# EasyEDA Pro project MSDRV3.eprj, board PCB7
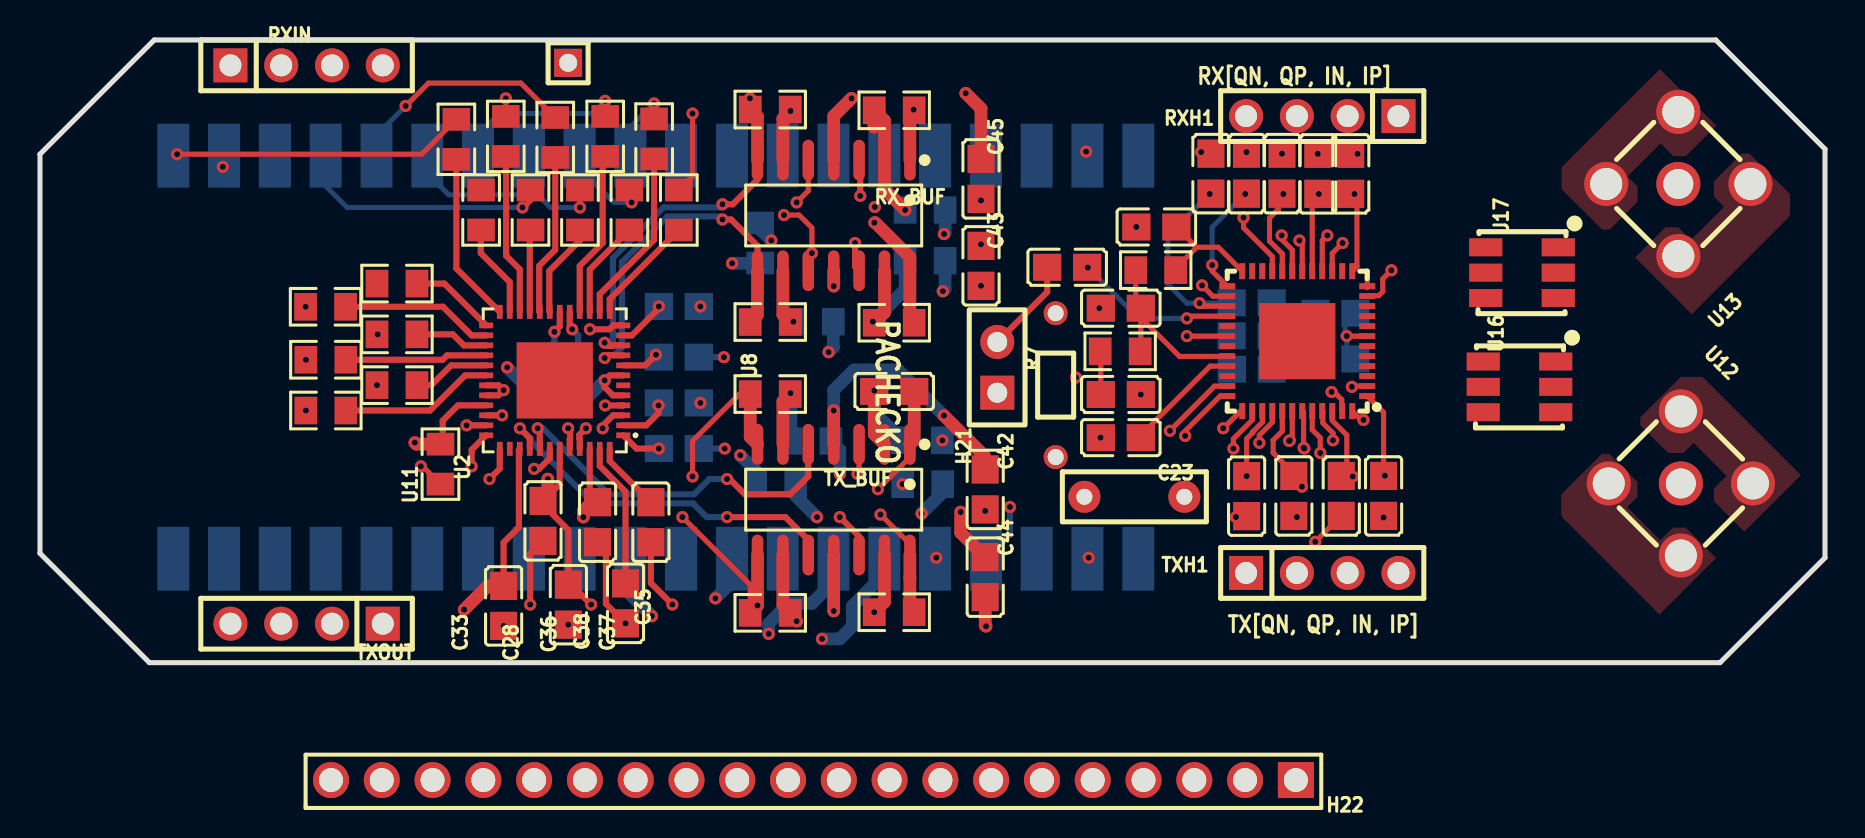
[diagram p12: board, top side]
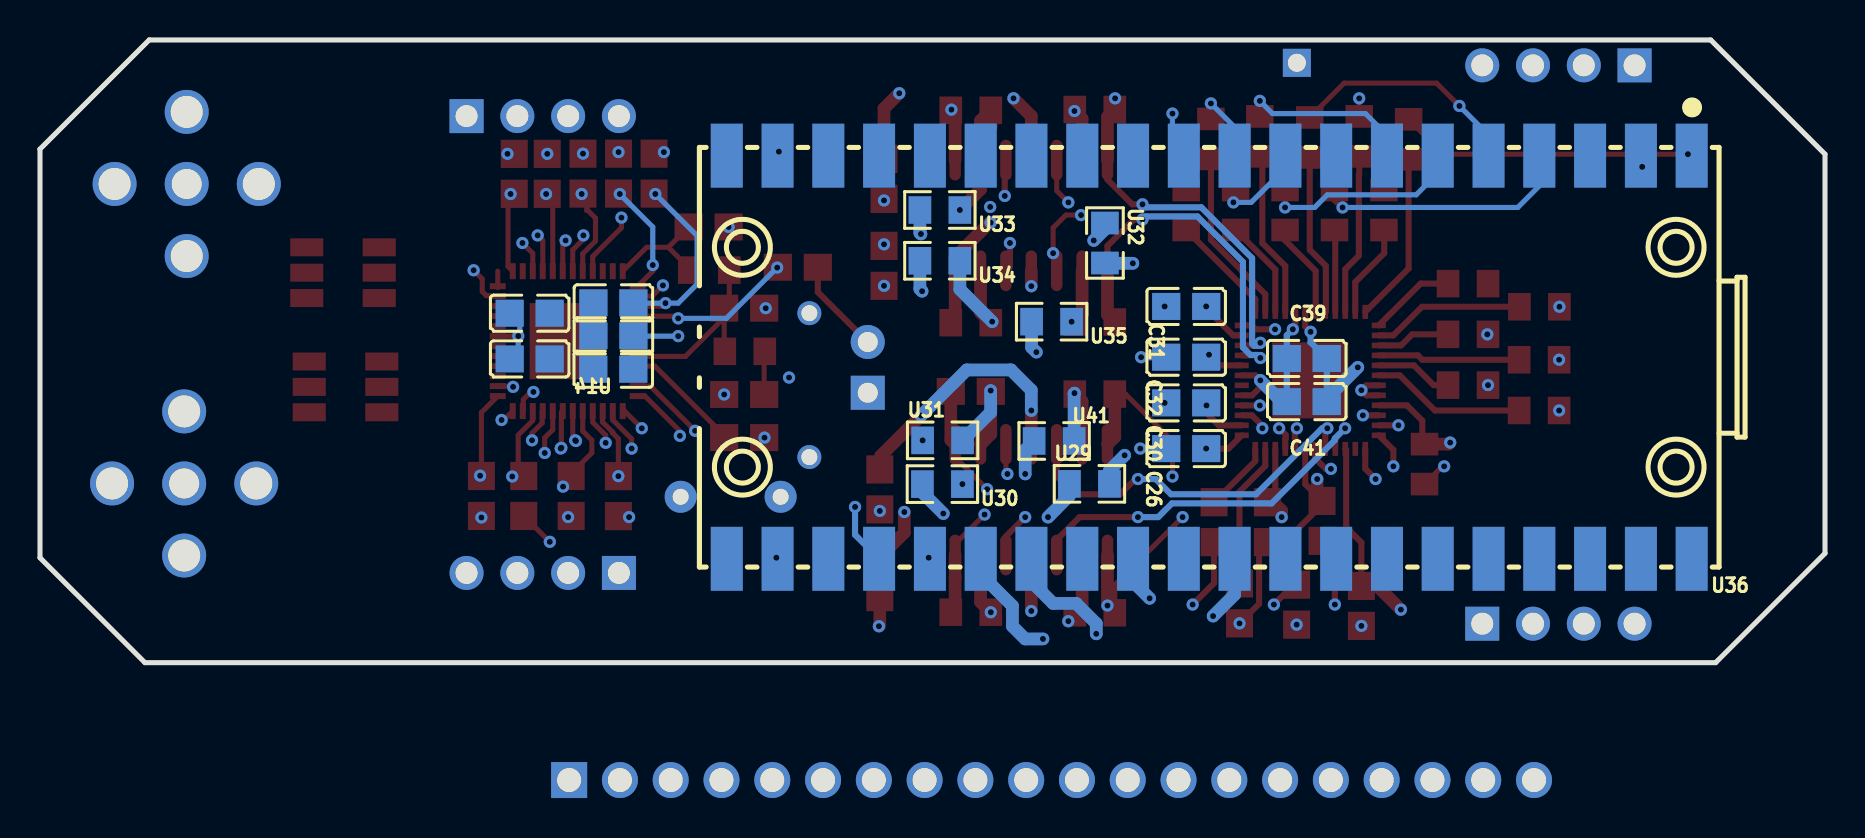
[diagram p13: board, bottom side, seen from below]

Outline 89.28 x 31.16 mm; copper layers: Top Layer, GND, Inner2, Inner3, 3.3V, Bottom Layer. Coordinates in mm from the lower left corner of the outline.
Outline path: 0,25.44 0,5.47 5.47,0 84.03,0 89.28,5.25 89.28,25.7 83.82,31.16 5.72,31.16 0,25.44
Stack: Top Layer 0.035mm 外层铜厚1oz / Dielectric1 0.0994mm 3313 RC57% 4.2mil / GND 0.0152mm 内层铜厚 / Dielectric2 0.55mm 0.55mm H/H不含铜 / Inner2 0.0152mm 内层铜厚 / Dielectric3 0.1088mm 2116 RC54% 4.9mil / Inner3 0.0152mm 内层铜厚 / Dielectric4 0.55mm 0.55mm H/H不含铜 / 3.3V 0.0152mm 内层铜厚 / Dielectric5 0.0994mm 3313 RC57% 4.2mil / Bottom Layer 0.035mm 外层铜厚1oz

## Design rules (mm)
net $1I37/RXP: $1I37/RX
net $1I37/RXN: $1I37/RX
net $1I37/TXP: $1I37/TX
net $1I37/TXN: $1I37/TX
net $1I37/RXQN: $1I37/RXQ
net $1I37/RXQP: $1I37/RXQ
net $1I37/RXIN: $1I37/RXI
net $1I37/RXIP: $1I37/RXI
net $1I37/TXQN: $1I37/TXQ
net $1I37/TXQP: $1I37/TXQ
net $1I37/TXIN: $1I37/TXI
net $1I37/TXIP: $1I37/TXI
template: JLCPCB Capability(Two Layers Board)
spacing copperThickness1oz (default): track to track 0.102, other pairs 0.152 to 0.3
spacing copperThickness2oz: track to track 0.203, other pairs 0.152 to 0.3
track width copperThickness1oz (default): min 0.127, default 0.254, max 2.54
track width copperThickness2oz: min 0.203, default 0.254, max 2.54
differential pair differentialPair (default): width min 0.127, default 0.254, max 2.54; gap min 0.152, default 0.152
via viaSize (default): diameter min 0.5, default 0.61, max 10; hole min 0.3, default 0.305, max 6.3

## Placement (name value [footprint] x y rotation side)
C18  100nF  [C0805]  54.06 11.26 0 top
C19  100nF  [C0805]  51.38 19.78 0 top
C20  100pF  [C0805]  55.84 21.8 0 top
C21  2200pF  [C0805]  54.06 13.42 180 top
C22  68pF  [C0805]  54.06 17.74 0 top
C23  470nF  [CAP-TH_L7.2-W2.5-P5.00-D0.5]  54.74 8.3 180 top
C26  330nF  [C0805]  31.95 10.71 180 bottom
C28  100nF  [C0805]  25.16 7.09 90 top
C30  100nF  [C0805]  31.95 13 0 bottom
C31  100nF  [C0805]  31.95 17.82 180 bottom
C32  100nF  [C0805]  31.95 15.28 180 bottom
C33  100nF  [C0805]  23.19 2.84 270 top
C35  330nF  [C0805]  30.56 7.03 270 top
C36  100nF  [C0805]  26.43 2.9 90 top
C37  330nF  [C0805]  29.29 2.97 90 top
C38  100nF  [C0805]  27.89 7.03 90 top
C39  100nF  [C0805]  25.92 15.22 180 bottom
C40  100nF  [C0805]  42.73 13.57 0 top
C41  100nF  [C0805]  25.92 13.06 180 bottom
C42  330nF  [C0805]  47.28 8.67 90 top
C43  330nF  [C0805]  47.07 19.86 270 top
C44  330nF  [C0805]  47.28 4.28 270 top
C45  330nF  [C0805]  47.07 24.21 90 top
CLNA  100pF  [C0805]  67.2 8.34 270 top
CPA  100nF  [C0805]  65.56 24.46 90 top
CPA1  10uF  [C0805]  64.79 17.48 180 bottom
CPA2  10uF  [C0805]  64.79 15.2 180 bottom
CPLL  100pF  [C0805]  62.12 24.47 90 top
CRXMX  100pF  [C0805]  65.09 8.34 270 top
CTXMX  100pF  [C0805]  63.91 24.46 90 top
CVCCCP  10nF  [C0805]  60.34 24.47 90 top
CVCO0  100pF  [C0805]  60.6 18.01 0 bottom
CVCO1  100pF  [C0805]  60.6 16.35 0 bottom
CVCO2  100pF  [C0805]  60.61 14.68 0 bottom
CVRXA  100pF  [C0805]  60.35 8.33 270 top
CVRXF  100pF  [C0805]  62.71 8.34 270 top
CVXTAL  100pF  [C0805]  58.57 24.47 90 top
H12  -  [HDR-TH_1P-V-M_XKB_X4611WV-01I-C28D40]  26.42 30.02 180 top
H21  -  [HDR-TH_2P-P2.54-V-F]  47.88 14.78 90 top
H22  -  [HDR-TH_20P-P2.54-V-M-1]  38.68 -5.88 180 top
R7  10kΩ  [RES-TH_BD1.8-L3.2-P7.20-D0.4]  50.8 13.89 270 top
RX_BUF  CLC4601ISO14X  [SOIC-14_L8.7-W3.9-P1.27-LS6.0-BL]  39.7 22.38 180 top
RXH1  -  [HDR-TH_4P-P2.54-V-M]  64.14 27.35 180 top
RXIN  -  [HDR-TH_4P-P2.54-V-F]  13.34 29.89 0 top
TX_BUF  CLC4601ISO14X  [SOIC-14_L8.7-W3.9-P1.27-LS6.0-BL]  39.7 8.15 180 top
TXH1  -  [HDR-TH_4P-P2.54-V-M]  64.14 4.49 0 top
TXOUT  -  [HDR-TH_4P-P2.54-V-F]  13.34 1.95 180 top
U1  100  [R0805]  14.3 12.62 0 top
U2  MAX5864ETM+  [QFN-48_L7.0-W7.0-P0.50-BL-EP5.1]  25.75 14.13 90 top
U3  1120  [R0805]  36.52 2.49 0 top
U4  1120  [R0805]  42.73 27.64 0 top
U5  1120  [R0805]  42.73 17.01 180 top
U6  1120  [R0805]  36.52 17.04 0 top
U7  1120  [R0805]  36.52 27.68 180 top
U8  1120  [R0805]  36.52 13.44 180 top
U9  100  [R0805]  17.86 13.89 0 top
U10  1120  [R0805]  42.73 2.52 180 top
U11  100  [R0805]  20.03 9.93 90 top
U12  MCX5.08-H5  [SMA-TH_MCX5.08-H5]  82.07 8.97 315 top
U13  MCX5.08-H5  [SMA-TH_MCX5.08-H5]  81.94 23.95 45 top
U14  MAX2831ETM+T  [TQFN-48_L7.0-W7.0-P0.50-TL-EP5.6]  62.88 16.09 180 top
U15  100  [R0805]  17.86 16.43 0 top
U16  TCM2-43X+  [IND-SMD_6P-L4.1-W3.8-P1.27-TL]  74 13.8 270 top
U17  TCM2-43X+  [IND-SMD_6P-L4.1-W3.8-P1.27-TL]  74.13 19.51 270 top
U18  100  [R0805]  20.83 26.19 90 top
U19  100  [R0805]  22.06 22.65 90 top
U20  1.2K  [R0805]  54.03 15.58 180 top
U21  750  [R0805]  55.81 19.64 0 top
U22  100  [R0805]  27.01 22.65 90 top
U23  100  [R0805]  28.27 26.33 90 top
U24  100  [R0805]  29.48 22.65 90 top
U25  100  [R0805]  30.72 26.21 90 top
U26  100  [R0805]  31.95 22.65 90 top
U27  100  [R0805]  14.3 15.16 0 top
U28  1120  [R0805]  25.77 26.28 90 top
U29  1120  [R0805]  36.79 8.95 180 bottom
U30  1120  [R0805]  44.14 8.93 0 bottom
U31  1120  [R0805]  44.14 11.12 180 bottom
U32  1120  [R0805]  36.02 21 270 bottom
U33  1120  [R0805]  44.27 22.65 0 bottom
U34  1120  [R0805]  44.27 20.11 0 bottom
U35  1120  [R0805]  38.68 17.06 0 bottom
U36  PICO  [COMM-SMD_L51.0-W21.0-P2.54_SC0916]  31.11 15.28 0 bottom
U37  100  [R0805]  14.28 17.81 0 top
U38  100  [R0805]  17.86 18.97 0 top
U39  100  [R0805]  23.3 26.33 90 top
U40  100  [R0805]  24.53 22.65 90 top
U41  1120  [R0805]  38.56 11.09 0 bottom

## Footprints (pads in the part's own frame, mm; a bottom-side part is the same pattern mirrored in y, then rotated)
C0805
  rect 1.41x1.35 smd: 1(-1,0) 2(1,0)
CAP-TH_L7.2-W2.5-P5.00-D0.5
  round 1.6 hole 0.8: 1(-2.5,0) 2(2.5,0)
COMM-SMD_L51.0-W21.0-P2.54_SC0916
  rect 1.6x3.2 smd: 1(-24.445,-10.088) 2(-21.905,-10.088) 3(-19.365,-10.088) 4(-16.825,-10.088) 5(-14.285,-10.088) 6(-11.745,-10.088) 7(-9.205,-10.088) 8(-6.665,-10.088) 9(-4.125,-10.088) 10(-1.585,-10.088) 11(0.955,-10.088) 12(3.495,-10.088) 13(6.035,-10.088) 14(8.575,-10.088) 15(11.115,-10.088) 16(13.655,-10.088) 17(16.195,-10.088) 18(18.735,-10.088) 19(21.275,-10.088) 20(23.815,-10.088) 21(23.815,10.088) 22(21.275,10.088) 23(18.735,10.088) 24(16.195,10.088) 25(13.655,10.088) 26(11.115,10.088) 27(8.575,10.088) 28(6.035,10.088) 29(3.495,10.088) 30(0.955,10.088) 31(-1.585,10.088) 32(-4.125,10.088) 33(-6.665,10.088) 34(-9.205,10.088) 35(-11.745,10.088) 36(-14.285,10.088) 37(-16.825,10.088) 38(-19.365,10.088) 39(-21.905,10.088) 40(-24.445,10.088)
HDR-TH_1P-V-M_XKB_X4611WV-01I-C28D40
  rect 1.4x1.4 hole 0.9: 1(0,0)
HDR-TH_2P-P2.54-V-F
  rect 1.7x1.7 hole 1: 1(-1.27,0)
  round 1.7 hole 1: 2(1.27,0)
HDR-TH_4P-P2.54-V-F
  rect 1.7x1.7 hole 1.1: 1(-3.81,0)
  round 1.7 hole 1.1: 2(-1.27,0) 3(1.27,0) 4(3.81,0)
HDR-TH_4P-P2.54-V-M
  rect 1.7x1.7 hole 1.1: 1(-3.81,0)
  round 1.7 hole 1.1: 2(-1.27,0) 3(1.27,0) 4(3.81,0)
HDR-TH_20P-P2.54-V-M-1
  rect 1.8x1.8 hole 1.2: 1(-24.13,0)
  round 1.8 hole 1.2: 2(-21.59,0) 3(-19.05,0) 4(-16.51,0) 5(-13.97,0) 6(-11.43,0) 7(-8.89,0) 8(-6.35,0) 9(-3.81,0) 10(-1.27,0) 11(1.27,0) 12(3.81,0) 13(6.35,0) 14(8.89,0) 15(11.43,0) 16(13.97,0) 17(16.51,0) 18(19.05,0) 19(21.59,0) 20(24.13,0)
IND-SMD_6P-L4.1-W3.8-P1.27-TL
  rect 0.9x1.657 smd: 1(-1.27,1.813) 2(0,1.813) 3(1.27,1.813) 4(1.27,-1.813) 5(0,-1.813) 6(-1.27,-1.813)
QFN-48_L7.0-W7.0-P0.50-BL-EP5.1
  rect 0.28x0.7 smd: 1(-2.75,-3.428) 2(-2.25,-3.428) 3(-1.75,-3.428) 4(-1.25,-3.428) 5(-0.75,-3.428) 6(-0.25,-3.428) 7(0.25,-3.428) 8(0.75,-3.428) 9(1.25,-3.428) 10(1.75,-3.428) 11(2.25,-3.428) 12(2.75,-3.428) 25(2.75,3.428) 26(2.25,3.428) 27(1.75,3.428) 28(1.25,3.428) 29(0.75,3.428) 30(0.25,3.428) 31(-0.25,3.428) 32(-0.75,3.428) 33(-1.25,3.428) 34(-1.75,3.428) 35(-2.25,3.428) 36(-2.75,3.428)
  rect 0.7x0.28 smd: 13(3.428,-2.75) 14(3.428,-2.25) 15(3.428,-1.75) 16(3.428,-1.25) 17(3.428,-0.75) 18(3.428,-0.25) 19(3.428,0.25) 20(3.428,0.75) 21(3.428,1.25) 22(3.428,1.75) 23(3.428,2.25) 24(3.428,2.75) 37(-3.428,2.75) 38(-3.428,2.25) 39(-3.428,1.75) 40(-3.428,1.25) 41(-3.428,0.75) 42(-3.428,0.25) 43(-3.428,-0.25) 44(-3.428,-0.75) 45(-3.428,-1.25) 46(-3.428,-1.75) 47(-3.428,-2.25) 48(-3.428,-2.75)
  rect 3.81x3.81 smd: 49(0,0)
R0805
  rect 1.133x1.377 smd: 1(-1,0) 2(1,0)
RES-TH_BD1.8-L3.2-P7.20-D0.4
  round 1.2 hole 0.8: 1(-3.6,0) 2(3.6,0)
SMA-TH_MCX5.08-H5
  round 2.2 hole 1.6: 1(-2.55,-2.55) 2(-2.55,2.55) 3(2.55,2.55) 4(2.55,-2.55)
  round 2.2 hole 1.5: 5(0,0)
SOIC-14_L8.7-W3.9-P1.27-LS6.0-BL
  oval 0.574x2.038 smd: 1(-3.81,-2.769) 2(-2.54,-2.769) 3(-1.27,-2.769) 4(0,-2.769) 5(1.27,-2.769) 6(2.54,-2.769) 7(3.81,-2.769) 8(3.81,2.769) 9(2.54,2.769) 10(1.27,2.769) 11(0,2.769) 12(-1.27,2.769) 13(-2.54,2.769) 14(-3.81,2.769)
TQFN-48_L7.0-W7.0-P0.50-TL-EP5.6
  rect 0.8x0.3 smd: 1(-3.5,2.751) 2(-3.5,2.251) 3(-3.5,1.75) 4(-3.5,1.251) 5(-3.5,0.75) 6(-3.5,0.252) 7(-3.5,-0.249) 8(-3.5,-0.75) 9(-3.5,-1.25) 10(-3.5,-1.75) 11(-3.5,-2.249) 12(-3.5,-2.748) 25(3.5,-2.748) 26(3.5,-2.249) 27(3.5,-1.75) 28(3.5,-1.25) 29(3.5,-0.75) 30(3.5,-0.249) 31(3.5,0.252) 32(3.5,0.75) 33(3.5,1.251) 34(3.5,1.75) 35(3.5,2.251) 36(3.5,2.751)
  rect 0.3x0.8 smd: 13(-2.751,-3.5) 14(-2.251,-3.5) 15(-1.75,-3.5) 16(-1.25,-3.5) 17(-0.75,-3.5) 18(-0.251,-3.5) 19(0.249,-3.5) 20(0.75,-3.5) 21(1.25,-3.5) 22(1.75,-3.5) 23(2.251,-3.5) 24(2.751,-3.5) 37(2.751,3.5) 38(2.251,3.5) 39(1.75,3.5) 40(1.25,3.5) 41(0.75,3.5) 42(0.251,3.5) 43(-0.251,3.5) 44(-0.75,3.5) 45(-1.25,3.5) 46(-1.75,3.5) 47(-2.251,3.5) 48(-2.751,3.5)
  rect 3.81x3.81 smd: 49(0,0.001)

## Nets
+5V: C42.2 C45.2 RX_BUF.4 TX_BUF.4
-5V: C43.2 C44.2 RX_BUF.11 TX_BUF.11
GND: C18.1 C20.1 C21.1 C22.1 C23.1 C26.1 C28.1 C30.2 C31.1 C32.1 C33.2 C35.2 C36.1 C37.1 C38.1 C39.1 C40.1 C41.1 C42.1 C43.1 C44.1 C45.1 CLNA.2 CPA.2 CPA1.2 CPA2.2 CPLL.2 CRXMX.2 CTXMX.2 CVCCCP.2 CVCO0.2 CVCO1.2 CVCO2.2 CVRXA.2 CVRXF.2 CVXTAL.2 U2.5 U2.7 U2.12 U2.17 U2.31 U2.32 U2.37 U2.42 U12.1 U12.2 U12.3 U12.4 U13.1 U13.2 U13.3 U13.4 U14.2 U14.26 U14.31 U14.47 U16.1 U16.2 U17.1 U17.2 U28.2 U29.2 U30.2 U31.1 U32.2 U33.2 U34.2 U35.2
3.3: C28.2 C30.1 C31.2 C32.2 C33.1 C36.2 C38.2 C39.2 C40.2 C41.2 CLNA.1 CPA.1 CPA1.1 CPA2.1 CPLL.1 CRXMX.1 CTXMX.1 CVCCCP.1 CVCO0.1 CVCO1.1 CVCO2.1 CVRXA.1 CVRXF.1 CVXTAL.1 U2.2 U2.8 U2.11 U2.18 U2.33 U2.39 U2.43 U2.46 U14.1 U14.7 U14.13 U14.17 U14.20 U14.25 U14.27 U14.30 U14.39 U14.41 U14.46
$1I37/BYPASS: C18.2 U14.33
$1I37/CLKBUF: H12.1 U14.21
$1I37/CPOUT: C20.2 U14.24 U21.2
$1I37/D1: U14.23
$1I37/D2: U14.11
$1I37/D3: U14.8
$1I37/D4: U14.34
$1I37/D5: U14.14
$1I37/D6: U14.3
$1I37/D7: U14.6
$1I37/NET1: R7.1 U14.16
$1I37/PLL_LOCK: U14.22
$1I37/PLLCLK: C19.1 H21.2
$1I37/RSSI: C23.2 R7.2
$1I37/RXHP: U14.40
$1I37/RXIN: RXH1.2 U14.37
$1I37/RXIP: RXH1.1 U14.38
$1I37/RXN: U14.5 U16.6
$1I37/RXP: U14.4 U16.4
$1I37/RXQN: RXH1.4 U14.35
$1I37/RXQP: RXH1.3 U14.36
$1I37/RXTX_MODE: U14.48
$1I37/SHDN#: U14.12
$1I37/TUNE: C22.2 U14.32 U20.1 U21.1
$1I37/TXIN: TXH1.3 U14.44
$1I37/TXIP: TXH1.4 U14.45
$1I37/TXN: U14.10 U17.6
$1I37/TXP: U14.9 U17.4
$1I37/TXQN: TXH1.1 U14.42
$1I37/TXQP: TXH1.2 U14.43
$1I37/XTAL: C19.2 U14.28
$1I1081/BBC_CLK: U2.6
$1I1081/BBC_DD0: U18.2
$1I1081/BBC_IN: TX_BUF.12 U2.44
$1I1081/BBC_IP: TX_BUF.3 U2.45
$1I1081/BBC_QN: TX_BUF.10 U2.40
$1I1081/BBC_QP: TX_BUF.5 U2.41
$1I1081/RX_BBCIN: RX_BUF.1 U2.4 U4.2
$1I1081/RX_BBCIP: RX_BUF.14 U2.3 U5.1
$1I1081/RX_BBCQN: RX_BUF.8 U2.9 U6.1
$1I1081/RX_BBCQP: RX_BUF.7 U2.10 U7.2
$1I1081/RXIN: RX_BUF.3 RXIN.4
$1I1081/RXIP: RX_BUF.12 RXIN.3
$1I1081/RXQN: RX_BUF.10 RXIN.1
$1I1081/RXQP: RX_BUF.5 RXIN.2
$1I1081/TXIN: TX_BUF.14 TXOUT.1 U10.1
$1I1081/TXIP: TX_BUF.1 TXOUT.2 U41.2
$1I1081/TXQN: TX_BUF.8 TXOUT.3 U3.1
$1I1081/TXQP: TX_BUF.7 TXOUT.4 U8.2
$1I37/$1N13355: U12.5 U16.3
$1I37/$1N19235: H21.1
$1I37/$1N20170: U13.5 U17.3
$1I37/$1N20400: C21.2 U20.2
$1I1081/$1N3982: C37.2 U2.47
$1I1081/$1N8783: RX_BUF.2 U4.1 U33.1
$1I1081/$1N8787: RX_BUF.6 U7.1 U32.1
$1I1081/$1N8791: RX_BUF.9 U6.2 U35.1
$1I1081/$1N8799: RX_BUF.13 U5.2 U34.1
$1I1081/$1N9382: TX_BUF.2 U31.2 U41.1
$1I1081/$1N9385: TX_BUF.6 U8.1 U28.1
$1I1081/$1N9388: TX_BUF.13 U10.2 U30.1
$1I1081/$1N9391: TX_BUF.9 U3.2 U29.1
$1I1081/$1N10591: U2.30 U11.2
$1I1081/$1N10629: U1.2 U2.29
$1I1081/$1N10667: U2.28 U9.2
$1I1081/$1N10705: U2.27 U27.2
$1I1081/$1N10743: U2.26 U15.2
$1I1081/$1N10781: U2.25 U37.2
$1I1081/$1N10830: U2.24 U38.1
$1I1081/$1N10868: U2.23 U18.1
$1I1081/$1N10906: U2.22 U19.1
$1I1081/$1N10944: U2.21 U39.1
$1I1081/$1N10982: U2.20 U40.1
$1I1081/$1N11020: U2.19 U22.1
$1I1081/$1N11058: U2.16 U23.1
$1I1081/$1N11162: U2.15 U24.1
$1I1081/$1N11200: U2.14 U25.1
$1I1081/$1N11238: U2.13 U26.1
$1I1081/$1N11679: C35.1 U2.48
$1I1081/$1N11690: C26.2 U2.1
$1N1035: U2.35 U14.18 U36.24
$1N1054: U2.34 U14.19 U36.25
$1N1076: U2.36 U36.22
$1N1476: U14.15 U36.19
$1N1492: U36.1 U38.2
$1N1503: U19.2 U36.2
$1N1510: U36.4 U39.2
$1N1517: U36.5 U40.2
$1N1524: U22.2 U36.6
$1N1531: U23.2 U36.7
$1N1538: U24.2 U36.9
$1N1545: U25.2 U36.10
$1N1559: U26.2 U36.11
$1N1698: U11.1 U36.34
$1N1703: U1.1 U36.32
$1N1708: U9.1 U36.31
$1N1713: U27.1 U36.29
$1N1718: U15.1 U36.27
$1N1726: U36.26 U37.1

Pads without a net: H22 1 2 3 4 5 6 7 8 9 10 11 12 13 14 15 16 17 18 19 20; U2 38 49; U14 29 49; U16 5; U17 5; U36 3 8 12 13 14 15 16 17 18 20 21 23 28 30 33 35 36 37 38 39 40

## Via types
v1: diameter 0.61, hole 0.305, Top Layer to Bottom Layer, 162 vias

## Routing (per net, layer and track width the routed paths; a pad name or vN(x,y) marks a point on that pad's centre or on a via; arc(x,y) is an arc through that point)
+5V: length 26.5
  Top Layer w0.635: RX_BUF.4 39.7,27.35 v1(40.59,28.24) ; v1(45.21,12.36) 47.23,10.34 47.23,9.54 ; v1(46.3,28.49) 47.07,27.73 C45.2 ; TX_BUF.4 v1(39.7,12.62)
  Inner2 w0.635: v1(46.3,28.49) 45.85,28.94 41.29,28.94 v1(40.59,28.24)
  Bottom Layer w0.635: v1(39.7,12.62) 39.7,13.63 40.71,14.65 42.93,14.65 v1(45.21,12.36)
-5V: length 13.6
  Top Layer w0.635: v1(39.7,18.84) 39.7,19.61 ; 39.7,2.58 TX_BUF.11 ; C44.2 47.28,1.86 v1(47.32,1.82)
  Inner2 w0.635: v1(47.07,18.86) 45.68,20.24 41.1,20.24 v1(39.7,18.84)
  vias: v1(39.7,2.58)
GND: length 47.6
  Top Layer w0.254: CRXMX.2 65.08,7.34 v1(63.78,6.05) ; U14.2 65.86,13.84 65.82,13.8 v1(65.62,13.8) ; U14.47 65.11,12.61 65.11,13.16 64.73,13.55 v1(64.6,13.55) ; U14.26 58.67,18.34 v1(58.12,18.88)
  Top Layer w0.305: U2.12 28.67,16.88 28.48,16.68 v1(27.51,16.68) ; C35.2 30.56,3.98 v1(31.63,2.91) ; U2.31 22.95,13.88 v1(23.19,13.63) 22.93,13.38 U2.32 ; v1(24.52,2.91) 24.52,5.45 C28.1 ; U2.37 23,9.7 v1(22.48,9.19) ; U2.42 25.5,10.22 24.97,9.7 v1(24.71,9.7) ; U2.7 28.49,14.38 v1(28.24,14.13) 28.24,13.79 28.65,13.38 U2.5 ; v1(29.29,1.97) 28.31,2.94 28.31,5.61 C38.1 ; U2.17 26.5,16.8 v1(26.62,16.68)
  Top Layer w0.635: v1(46.05,7.54) 46.05,6.51 C44.1
  Bottom Layer w0.305: v1(34.21,15.28) C32.1 ; C41.1 C39.1 26.92,16.38 v1(26.62,16.68) ; v1(34.25,10.71) C26.1
  Bottom Layer w0.635: U30.2 45.14,8.51 v1(44.1,7.46) ; C41.1 27.18,13.06 v1(28.24,14.13) ; U35.2 39.68,15.78 v1(39.45,15.54) ; U32.2 36,19.98 v1(34.62,19.98) ; U33.2 45.27,21.5 v1(45.22,21.45) ; v1(35.03,10.38) 35.79,9.61 U29.2 ; U34.2 45.27,18.7 v1(45.16,18.59)
  vias: v1(23.19,1.84) v1(26.43,1.9) v1(33.03,17.82) v1(33.03,13) v1(41.73,13.61) v1(45.14,11.12) v1(47.07,23.13) v1(47.07,20.93) v1(47.28,7.59) v1(52.98,17.74) v1(53.04,11.26) v1(54.84,21.8) v1(55.06,13.42) v1(58.08,25.55) v1(59.82,7.28) v1(60.34,25.55) v1(62.12,25.47) v1(62.86,7.28) v1(63.91,25.46) v1(65.9,25.46) v1(67.2,7.26)
3.3: length 95.1
  Top Layer w0.254: v1(58.63,19.9) 58.63,19.59 U14.25 ; 61.13,12.59 61.15,12.57 61.15,12.04 60.63,11.53 60.66,11.51 60.35,11.2 v1(60.35,9.33) ; CVRXF.1 62.71,9.21 v1(63.12,8.81) ; U14.13 65.87,19.82 65.87,23.32 v1(65.74,23.45) ; v1(63.97,23.45) 63.63,23.12 U14.17 ; v1(65.66,9.31) 65.36,9.61 65.36,11.39 64.63,12.11 U14.46 ; v1(58,17.99) 58.15,17.84 U14.27 ; U14.20 62.14,20.46 61.5,21.1 61.5,22.25 61.88,22.63 61.93,22.63 61.93,23.2 v1(62.19,23.45) ; 62.7,9.48 61.68,10.5 61.68,11.13 62.14,11.59 U14.41 ; v1(65.36,16.34) 65.36,16.34 U14.7 ; v1(57.36,16.34) 57.36,16.34 U14.30 ; U14.1 67.2,12.52 67.2,9.42 v1(67.27,9.35)
  Top Layer w0.305: v1(30.95,17.82) 30.95,17.72 29.6,16.38 U2.11 ; 27.75,8.17 27.5,8.42 U2.46 ; U2.18 26,16.82 v1(25.73,16.55) ; C33.1 23.19,6.01 23.95,6.78 23.95,10.65 U2.39 ; v1(30.94,12.87) 30.94,12.49 30.32,11.88 U2.2 ; 25.4,8.33 26,8.93 U2.43 ; C28.2 25.16,7.9 26.43,6.63 C36.2 26.57,3.9 v1(27.57,2.91) ; U2.8 30.27,14.88 v1(30.81,15.41) ; U2.33 20.91,12.88 20.14,12.11 20.14,11.05 20.03,10.93
  Top Layer w0.635: C28.2 25.4,8.33 v1(25.4,9.19) ; v1(21.21,2.65) 22.4,3.84 C33.1 ; v1(27.18,7.28) 27.18,7.6 27.75,8.17 C38.2 ; v1(18.75,11.01) 18.83,10.93 20.03,10.93
  Bottom Layer w0.254: 65.28,17.48 65.28,16.42 v1(65.36,16.34) 65.36,15.28 65.28,15.2 ; v1(57.36,16.34) 59.59,16.34 CVCO1.1 ; v1(60.28,23.45) 58.63,21.8 v1(58.63,19.9) ; CVCO0.1 59.59,17.99 v1(58,17.99) 57.36,17.99 56.42,18.94 56.42,21.36 v1(58.5,23.45)
  Bottom Layer w0.305: v1(25.73,16.55) 25.73,16.03 C39.2 24.92,13.22
  Bottom Layer w0.635: v1(30.94,12.87) 30.95,12.89 C30.1 ; v1(23.37,14.78) 24.92,13.22 C41.2 ; v1(30.81,15.41) 30.94,15.28 C32.2
$1I37/BYPASS: length 5.9
  Top Layer w0.254: U14.33 58.53,14.84 55.06,11.37 C18.2
$1I37/CLKBUF: length 40.3
  Top Layer w0.254: 61.63,19.59 61.63,20.32 60.2,21.76 v1(60.2,22.27)
  Inner3 w0.254: H12.1 37.97,30.02 45.54,22.45 60.02,22.45 v1(60.2,22.27)
$1I37/CPOUT: length 5.9
  Top Layer w0.254: 57.85,20.78 C20.2 ; 57.85,20.78 56.84,19.77 ; 57.85,20.78 58.94,20.78 U14.24 ; 56.84,19.77 56.81,19.74 U21.2 56.84,19.67 56.84,19.77
$1I37/D2: length 2.1
  Top Layer w0.254: v1(67.59,19.64) 67.16,19.2 67.16,18.57 66.96,18.36 66.41,18.36 U14.11
$1I37/NET1: length 17.6
  Top Layer w0.254: U14.16 64.13,21.12 v1(64.39,21.38)
  Inner3 w0.254: v1(64.39,21.38) 63.75,22.02 60.96,22.02 60.2,21.25 55.04,21.25 51.27,17.49 R7.1
$1I37/PLLCLK: length 4.8
  Top Layer w0.305: C19.1 50.38,18.54 47.88,16.05
$1I37/RSSI: length 2.6
  Inner3 w0.305: C23.2 50.8,9.74 R7.2
$1I37/RXHP: length 1.9
  Top Layer w0.254: v1(60.99,11) 60.99,11.38 61.63,12.03 61.63,12.59
$1I37/RXIN: length 21
  Top Layer w0.254: v1(59.18,11.73) 60.04,12.59 U14.37
  Inner2 w0.254: RXH1.2 66.43,27.35 66.52,27.26 66.52,19.39 60.43,13.29 60.43,12.97 v1(59.18,11.73)
$1I37/RXIP: length 22.9
  Top Layer w0.254: v1(59.69,10.71) 59.69,11.2 60.63,12.14 U14.38
  Inner2 w0.254: v1(59.69,10.71) 59.69,11.35 60.83,12.49 60.83,13.12 66.93,19.22 66.93,27.26 67.02,27.35 RXH1.1
$1I37/RXQN: length 21.8
  Top Layer w0.254: U14.35 58.75,13.84 56.52,11.61 v1(56.52,11.6)
  Inner2 w0.254: RXH1.4 61.09,26.59 61.09,16.98 57.02,12.92 57.02,12.11 v1(56.52,11.6)
$1I37/RXQP: length 21.4
  Top Layer w0.254: U14.36 59.02,13.34 57.28,11.59 v1(57.28,11.35)
  Inner2 w0.254: v1(57.28,11.35) 57.53,11.6 57.53,12.85 61.49,16.81 61.49,25.98 RXH1.3
$1I37/RXTX_MODE: length 0.7
  Top Layer w0.254: U14.48 66.08,12.14 v1(66.2,12.14)
$1I37/SHDN#: length 0.8
  Top Layer w0.254: 66.38,18.77 U14.12 66.38,19.59
$1I37/TUNE: length 9.3
  Top Layer w0.254: U14.32 59.37,15.32 57,15.32 55.06,17.26 ; 55.06,17.26 55.06,15.61 U20.1 ; 55.06,17.26 C22.2 54.81,17.99 U21.1
$1I37/TXIN: length 10.4
  Top Layer w0.254: U14.44 63.63,11.66 64.04,11.25 v1(64.04,10.49)
  Inner2 w0.254: TXH1.3 66.43,4.49 66.52,4.58 66.52,5.92 64.57,7.88 64.57,9.53 64.04,10.06 v1(64.04,10.49)
$1I37/TXIP: length 10.2
  Top Layer w0.254: v1(64.67,11.13) 64.67,11.48 64.16,11.99 64.16,12.56 U14.45
  Inner2 w0.254: v1(64.67,11.13) 64.98,10.82 64.98,8.05 66.93,6.09 66.93,4.58 67.02,4.49 TXH1.4
$1I37/TXQN: length 9.8
  Top Layer w0.254: U14.42 62.63,11.25 v1(62.51,11.13) v1(62.48,11.09)
  Inner2 w0.254: v1(62.48,11.09) 62.48,10.32 62.64,10.16 62.64,10.03 61.39,8.79 61.39,4.58 61.3,4.49 TXH1.1
$1I37/TXQP: length 9.8
  Top Layer w0.254: v1(63.2,10.75) v1(63.24,10.72) ; U14.43 63.2,12.52 63.2,10.75
  Inner2 w0.254: v1(63.2,10.75) 63.2,10.32 63.04,10.16 63.04,9.8 61.8,8.56 61.8,4.58 61.89,4.49 TXH1.2
$1I37/XTAL: length 8.1
  Top Layer w0.254: U14.28 57.47,17.34 v1(57.36,17.23)
  Bottom Layer w0.254: v1(52.41,19.77) 54.95,17.23 v1(57.36,17.23)
$1I1081/BBC_IN: length 19
  Top Layer w0.305: v1(26.42,11.73) 26.52,11.63 26.52,11.22 26.5,11.2 U2.44 ; TX_BUF.12 40.97,6.32 v1(40.01,7.28)
  Inner2 w0.305: v1(40.01,7.28) 39.32,7.97 29.81,7.97 26.52,11.26 26.52,11.63 v1(26.42,11.73)
$1I1081/BBC_IP: length 18.6
  Top Layer w0.254: v1(40.89,9.44) 40.97,9.52 TX_BUF.3
  Top Layer w0.305: U2.45 27,11.2 26.97,11.22 26.97,11.4 v1(27.3,11.73)
  Inner2 w0.305: v1(40.89,9.44) 40.01,8.55 29.87,8.55 26.97,11.45 27.03,11.45 v1(27.3,11.73)
$1I1081/BBC_QN: length 18.8
  Top Layer w0.305: v1(34.37,7.28) 37.29,7.28 38.43,6.14 38.43,5.39 ; v1(24,11.73) 24.51,11.22 24.52,11.22 24.5,11.2 U2.40
  Bottom Layer w0.305: v1(24,11.73) 24.52,11.21 24.52,11.13 27.68,7.97 32.66,7.97 33.35,7.28 v1(34.37,7.28)
$1I1081/BBC_QP: length 18.6
  Top Layer w0.305: U2.41 25,11.62 v1(24.89,11.73) ; v1(34.37,9.19) 34.49,9.19 35.25,8.43 37.53,8.43 38.43,9.33 TX_BUF.5
  Bottom Layer w0.305: v1(24.89,11.73) 25.15,11.73 28.45,8.43 32.71,8.43 33.48,9.19 v1(34.37,9.19)
$1I1081/RX_BBCIN: length 26.8
  Top Layer w0.305: v1(28.27,12.87) 29.17,12.87 U2.4
  Top Layer w0.635: RX_BUF.1 43.51,27.42 U4.2 43.69,27.67
  Inner2 w0.305: v1(28.27,12.87) 28.29,12.85 28.55,12.85 30.09,14.39 30.94,14.39 39.19,22.65 41.6,22.65 v1(41.76,22.8) 41.77,22.82
  Inner2 w0.635: v1(43.69,27.67) 43.51,27.49 43.51,24.55 41.77,22.82
$1I1081/RX_BBCIP: length 25.2
  Top Layer w0.305: 41.77,22.03 41.74,22.03 v1(41.73,22.02) ; U2.3 28.66,12.38 28.14,11.86 v1(28.14,11.73)
  Top Layer w0.635: 41.77,22.03 43.51,20.29 RX_BUF.14 43.51,17.23 U5.1
  Inner2 w0.305: v1(41.73,22.02) 41.55,22.19 39.38,22.19 31.13,13.94 30.69,13.94 28.48,11.73 v1(28.14,11.73)
$1I1081/RX_BBCQN: length 18.7
  Top Layer w0.305: v1(34.14,22.17) 34.57,22.17 35.89,20.85 RX_BUF.8 ; U2.9 28.67,15.38 28.65,15.4 28.4,15.4 v1(28.24,15.24)
  Top Layer w0.635: U6.1 35.89,17.41 RX_BUF.8
  Bottom Layer w0.305: v1(34.14,22.17) 33.98,22.33 31.39,22.33 29.11,20.05 29.11,15.77 28.74,15.4 28.4,15.4 v1(28.24,15.24)
$1I1081/RX_BBCQP: length 18.9
  Top Layer w0.305: v1(34.14,22.94) 34.65,22.94 35.89,24.17 RX_BUF.7 ; v1(28.24,16.01) 28.4,15.85 28.65,15.85 28.67,15.88 U2.10 ; U7.2 35.51,27.69 v1(35.51,28.24)
  Top Layer w0.635: U7.2 35.89,27.31 RX_BUF.7
  Bottom Layer w0.305: v1(28.24,16.01) 28.4,15.85 28.55,15.85 28.66,15.96 28.66,20.24 31.2,22.78 33.98,22.78 v1(34.14,22.94)
$1I1081/RXIN: length 31.4
  Top Layer w0.305: RX_BUF.3 41.03,25.09 41.03,23.36
  Inner3 w0.254: v1(41.03,23.35) 41.03,22.91 40.64,22.52 39.76,22.52 35.44,26.84 17.93,26.84 16.26,28.52 16.26,29 RXIN.4
$1I1081/RXIP: length 31.5
  Top Layer w0.305: 40.77,21 40.77,19.81 RX_BUF.12
  Inner3 w0.254: v1(40.77,21) 40.7,21 35.32,26.38 17.81,26.38 14.61,29.59 RXIN.3
$1I1081/RXQN: length 33.9
  Top Layer w0.254: v1(37.21,22.4) 37.97,22.4 38.61,21.76 v1(38.61,20.49)
  Inner3 w0.254: RXIN.1 9.53,29.51 15.39,23.64 34.95,23.64 36.2,22.4 v1(37.21,22.4)
$1I1081/RXQP: length 33.7
  Top Layer w0.254: RX_BUF.5 38.43,23.61 v1(37.85,23.03)
  Inner3 w0.254: v1(37.85,23.03) 36.13,23.03 35.12,24.05 15.62,24.05 10.8,28.87 10.8,29.25 11.43,29.89 RXIN.2
$1I1081/TXIN: length 36.3
  Top Layer w0.254: 43.51,4.24 43.57,4.24 43.51,4.3 ; v1(42.04,7.41) 43.51,5.94 TX_BUF.14
  Top Layer w0.635: TX_BUF.14 43.51,2.74 U10.1
  Inner3 w0.254: TXOUT.1 16.17,1.95 16.08,2.04 16.08,3.55 18.54,6.01 36.16,6.01 38.07,7.92 38.48,7.92 38.52,7.88 41.57,7.88 v1(42.04,7.41)
$1I1081/TXIP: length 38
  Top Layer w0.254: TX_BUF.1 43.51,10.28 v1(41.91,8.68)
  Top Layer w0.635: TX_BUF.1 43.73,11.14 43.73,13.57
  Inner3 w0.254: TXOUT.2 14.61,2.65 18.37,6.42 35.99,6.42 37.9,8.33 38.48,8.33 38.52,8.38 41.61,8.38 v1(41.91,8.68)
  Bottom Layer w0.635: v1(40.01,9.44) 40.01,10.64 U41.2
$1I1081/TXQN: length 36.1
  Top Layer w0.254: U3.1 35.52,3.89 v1(32.13,7.28)
  Top Layer w0.635: U3.1 v1(35.89,2.86) TX_BUF.8
  Inner3 w0.254: v1(32.13,7.28) 31.53,7.88 19.72,7.88 19.57,8.03 19.16,8.03 17.78,6.65 12.95,6.65 10.8,4.49 10.8,2.04 10.89,1.95 TXOUT.3
$1I1081/TXQP: length 36
  Top Layer w0.254: v1(32.64,9.31) 32.64,11.09 34.98,13.44 U8.2
  Top Layer w0.635: U8.2 35.52,11.29 TX_BUF.7
  Inner3 w0.254: TXOUT.4 10.3,1.95 10.39,2.04 10.39,4.66 12.79,7.05 17.61,7.05 19,8.44 19.57,8.44 19.72,8.59 31.92,8.59 v1(32.64,9.31)
$1I37/$1N20400: length 2.2
  Top Layer w0.254: U20.2 53.06,15.55 C21.2
$1I1081/$1N3982: length 7.3
  Top Layer w0.305: C37.2 29.29,8.55 28,9.84 U2.47
$1I1081/$1N8783: length 6.5
  Top Layer w0.635: 41.71,26.8 41.71,27.62 U4.1 42.24,27.13 RX_BUF.2 42.24,23.68 v1(43.27,22.65)
$1I1081/$1N8787: length 11.6
  Top Layer w0.635: v1(37.54,27.6) 37.16,27.22 RX_BUF.6
  Inner2 w0.635: v1(36.58,21.13) 35.83,21.87 35.83,22 ; 35.83,22 U32.1 ; 35.83,22 35.67,22 37.54,23.87 v1(37.54,27.6)
  Bottom Layer w0.635: v1(36.58,21.13) 36.02,21.69 U32.1
$1I1081/$1N8791: length 2.7
  Top Layer w0.635: U6.2 37.16,17.41 RX_BUF.9
  vias: v1(37.68,17.06)
$1I1081/$1N8799: length 6.6
  Top Layer w0.635: RX_BUF.13 42.24,17.52 U5.2 41.71,17.01 v1(41.66,17.06)
  Bottom Layer w0.635: U34.1 43.27,18.68 v1(41.66,17.06)
$1I1081/$1N9382: length 6
  Top Layer w0.635: 41.73,13.61 41.73,13.61 41.73,13.57 41.73,11.44 TX_BUF.2
  Bottom Layer w0.635: 41.73,13.61 41.73,12.53 U31.2
$1I1081/$1N9385: length 5.1
  Top Layer w0.635: TX_BUF.6 37.16,13.07 U8.1
  Bottom Layer w0.635: v1(37.54,13.49) 37.56,13.47 37.56,11.09
$1I1081/$1N9388: length 10.1
  Top Layer w0.635: TX_BUF.13 42.24,3.04 v1(41.73,2.52)
  Inner3 w0.635: v1(41.73,2.52) 41.73,2.56 43.14,3.98 v1(43.14,8.93)
$1I1081/$1N9391: length 11.8
  Top Layer w0.635: 37.56,2.49 37.16,2.89 TX_BUF.9 ; 37.56,2.49 37.56,2.36 v1(37.85,2.08) ; 37.56,2.49 U3.2
  Inner3 w0.635: v1(37.85,2.08) 37.85,2.24 37.59,2.49 ; 37.59,2.49 37.59,6.01 v1(38.86,7.28) ; 37.59,2.49 37.72,2.62
  Bottom Layer w0.635: U29.1 37.79,8.35 v1(38.86,7.28)
$1I1081/$1N10591: length 7.7
  Top Layer w0.305: 15.3,12.62 19.51,12.62 21.27,14.38 U2.30
$1I1081/$1N10629: length 3.9
  Top Layer w0.305: 18.86,13.89 19.57,13.89 20.56,14.88 U2.29
$1I1081/$1N10667: length 7.1
  Top Layer w0.305: 15.3,15.16 20.14,15.16 20.36,15.38 U2.28
$1I1081/$1N10705: length 3.7
  Top Layer w0.305: U2.27 21.2,15.88 20.65,16.43 18.86,16.43
$1I1081/$1N10743: length 7.6
  Top Layer w0.305: 15.28,17.81 20.16,17.81 21.59,16.38 U2.26
$1I1081/$1N10781: length 4.3
  Top Layer w0.305: U2.25 20.23,18.97 18.86,18.97
$1I1081/$1N10830: length 8.5
  Top Layer w0.305: U2.24 20.83,19.72 20.83,25.19
$1I1081/$1N10868: length 4.7
  Top Layer w0.305: 22.06,21.65 22.05,21.63 22.05,20.49 23.5,19.04 U2.23
$1I1081/$1N10906: length 8.1
  Top Layer w0.305: 23.3,25.33 23.3,24.45 23.32,24.43 23.32,20.36 24,19.69 U2.22
$1I1081/$1N10944: length 4.1
  Top Layer w0.305: 24.53,21.65 24.5,21.61 U2.21
$1I1081/$1N10982: length 8.1
  Top Layer w0.305: 25.77,25.28 25.77,20.66 24.97,19.86 24.97,17.58 U2.20
$1I1081/$1N11020: length 4.7
  Top Layer w0.305: U22.1 27.01,21.13 25.48,19.6 25.48,17.57 U2.19
$1I1081/$1N11058: length 8.2
  Top Layer w0.305: U2.16 27,19.85 28.14,21 28.14,25.18 28.24,25.28
$1I1081/$1N11162: length 4.9
  Top Layer w0.305: U2.15 27.5,19.67 U24.1
$1I1081/$1N11200: length 8.8
  Top Layer w0.305: U25.1 30.72,21.16 28,18.44 U2.14
$1I1081/$1N11238: length 5.5
  Top Layer w0.305: U2.13 28.5,18.19 U26.1
$1I1081/$1N11679: length 3.5
  Top Layer w0.305: C35.1 28.5,10.09 U2.48
$1I1081/$1N11690: length 2.1
  Top Layer w0.305: v1(30.95,10.71) 29.84,10.71 U2.1
$1N1035: length 60.3
  Top Layer w0.254: v1(62.99,21.13) 63.13,20.98 U14.18
  Top Layer w0.305: U2.35 v1(21.34,11.88)
  Inner2 w0.305: v1(48.51,7.79) 49.78,7.79 51.82,9.82 56.62,9.82 58.04,11.25 58.04,12.36 62.99,17.32 v1(62.99,21.13)
  Inner3 w0.305: v1(48.51,7.79) 47.24,9.06 46.1,9.06 43.82,11.35 43.82,12.62 42.04,14.39 30.35,14.39 29.46,13.51 25.4,13.51 24.89,13 22.46,13 v1(21.34,11.88)
  Bottom Layer w0.305: v1(48.51,7.79) 48.51,6.4 U36.24
$1N1054: length 56.9
  Top Layer w0.254: v1(62.1,21.38) 62.1,21.19 62.64,20.66 U14.19
  Top Layer w0.305: U2.34 v1(23.11,12.38)
  Inner2 w0.305: v1(51.82,14.27) 44.83,7.28 v1(44.83,5.25)
  Inner3 w0.305: v1(23.11,12.38) 25.26,12.38 25.65,11.98 25.65,11.09 26.8,9.95 32.13,9.95 33.66,11.47 42.8,11.47 44.83,9.44 v1(44.83,5.25) ; v1(62.1,21.38) 61.34,20.62 58.17,20.62 v1(51.82,14.27)
  Bottom Layer w0.305: U36.25 44.78,5.2 v1(44.83,5.25)
$1N1076: length 35.9
  Top Layer w0.305: U2.36 21.59,10.65 v1(21.59,9.82)
  Inner2 w0.305: v1(52.45,5.25) 51.56,4.36 44.32,4.36 42.16,6.52 24.13,6.52 21.59,9.06 v1(21.59,9.82)
  Bottom Layer w0.305: v1(52.45,5.25) 52.4,5.2 U36.22
$1N1476: length 17.2
  Top Layer w0.254: v1(65.15,21) 64.63,20.48 U14.15
  Inner3 w0.254: v1(65.15,21) 65.15,21.51 64.01,22.65 63.63,22.65 63.12,23.16 63.12,23.41 62.23,24.3 53.21,24.3 52.32,25.19 v1(52.32,25.57)
  Bottom Layer w0.254: U36.19 52.32,25.44 v1(52.32,25.57)
$1N1492: length 14.9
  Top Layer w0.254: 20.83,27.19 19.08,25.44 v1(6.86,25.44)
  Bottom Layer w0.254: U36.1 6.79,25.37 v1(6.86,25.44)
$1N1503: length 16.5
  Top Layer w0.254: 23.3,27.33 v1(23.3,28.24)
  Inner2 w0.254: v1(23.3,28.24) 19.87,24.81 v1(9.14,24.81)
$1N1510: length 12.9
  Top Layer w0.254: v1(24.13,22.78) 24.19,22.78 24.53,23.12 24.53,23.65
  Bottom Layer w0.254: U36.4 14.29,23.85 15.37,22.78 v1(24.13,22.78)
$1N1517: length 11.8
  Top Layer w0.254: v1(18.29,27.86) 19.43,29 24.05,29 25.77,27.28
  Bottom Layer w0.254: v1(18.29,27.86) 16.83,26.4 U36.5
$1N1524: length 10.1
  Top Layer w0.254: U22.2 v1(27.01,22.78)
  Bottom Layer w0.254: v1(27.01,22.78) 25.53,22.78 24.89,23.41 20.45,23.41 19.37,24.49 U36.6
$1N1531: length 8.9
  Top Layer w0.254: U23.2 v1(28.27,28.11)
  Bottom Layer w0.254: 21.91,25.37 21.91,26.4 22.99,27.48 27.63,27.48 v1(28.27,28.11)
$1N1538: length 4.6
  Top Layer w0.254: U24.2 29.59,23.54 v1(29.59,23.03)
  Bottom Layer w0.254: v1(29.59,23.03) 28.7,23.03 27.05,24.68 27.05,25.31 U36.9
$1N1545: length 3.9
  Top Layer w0.254: U25.2 v1(30.72,27.98)
  Bottom Layer w0.254: v1(30.72,27.98) 29.53,26.8 U36.10
$1N1559: length 6.5
  Top Layer w0.254: v1(32.64,27.48) 32.64,24.34 U26.2
  Bottom Layer w0.254: U36.11 32.64,25.94 v1(32.64,27.48)
$1N1698: length 1.3
  Top Layer w0.254: U11.1 19.14,9.82 v1(19.05,9.82)
$1N1703:
  vias: v1(13.3,12.62)
$1N1708: length 3.3
  Bottom Layer w0.635: U36.31 29.53,3.41 v1(30.61,2.33)
  vias: v1(16.86,13.89)
$1N1713: length 2.4
  Top Layer w0.635: 16.89,16.43 16.86,16.43
  Bottom Layer w0.635: v1(33.78,3.22) 34.61,4.05 U36.29
  vias: v1(13.3,15.16)
$1N1718: length 5.8
  Bottom Layer w0.635: U36.27 39.69,4.05 38.61,2.97 37.46,2.97 36.45,1.96 v1(36.45,1.44)
  vias: v1(16.89,16.43)
$1N1726: length 5.8
  Bottom Layer w0.635: v1(39.12,1.19) 40.01,1.19 40.64,1.82 40.64,2.84 42.23,4.43 U36.26
  vias: v1(13.28,17.81)

## Copper pours and planes (outline as drawn; the poured copper is in the pictures)
GND on Top Layer: 76.08,10.45 83.83,10.45 83.83,2.41 76.08,2.41
GND on Top Layer: 79.78,25.48 87.53,25.48 87.53,17.44 79.78,17.44
GND on Top Layer: 76.1,29.7 83.85,29.7 83.85,21.67 76.1,21.67
GND on Top Layer: 80.04,14.3 88.08,14.3 88.08,6.55 80.04,6.55
GND on GND: 80.85,28.65 82.07,28.65 82.07,27.43 80.85,27.43
GND on GND: 80.98,6.45 82.2,6.45 82.2,5.23 80.98,5.23
GND on GND: 81.94,5.49 83.16,5.49 83.16,4.27 81.94,4.27
GND on GND: 78.33,10.06 79.55,10.06 79.55,8.84 78.33,8.84
GND on GND: 80.85,27.69 82.07,27.69 82.07,26.47 80.85,26.47
GND on GND: 78.21,25.04 79.43,25.04 79.43,23.82 78.21,23.82
GND on GND: 81.94,6.45 83.16,6.45 83.16,5.23 81.94,5.23
GND on GND: 85.42,24.08 86.64,24.08 86.64,22.86 85.42,22.86
GND on GND: 85.55,9.1 86.77,9.1 86.77,7.88 85.55,7.88
GND on GND: 0.26,30.9 89.02,30.9 89.02,0.26 0.26,0.26
GND on GND: 85.42,25.04 86.64,25.04 86.64,23.82 85.42,23.82
GND on GND: 84.46,24.08 85.68,24.08 85.68,22.86 84.46,22.86
GND on GND: 77.25,24.08 78.47,24.08 78.47,22.86 77.25,22.86
GND on GND: 81.81,20.48 83.03,20.48 83.03,19.26 81.81,19.26
GND on GND: 85.55,10.06 86.77,10.06 86.77,8.84 85.55,8.84
GND on GND: 80.85,21.44 82.07,21.44 82.07,20.22 80.85,20.22
GND on GND: 77.37,10.06 78.59,10.06 78.59,8.84 77.37,8.84
GND on GND: 80.98,12.7 82.2,12.7 82.2,11.48 80.98,11.48
GND on GND: 81.81,21.44 83.03,21.44 83.03,20.22 81.81,20.22
GND on GND: 81.94,12.7 83.16,12.7 83.16,11.48 81.94,11.48
GND on GND: 78.21,24.08 79.43,24.08 79.43,22.86 78.21,22.86
GND on GND: 84.46,25.04 85.68,25.04 85.68,23.82 84.46,23.82
GND on GND: 84.59,9.1 85.81,9.1 85.81,7.88 84.59,7.88
GND on GND: 81.81,28.65 83.03,28.65 83.03,27.43 81.81,27.43
GND on GND: 84.59,10.06 85.81,10.06 85.81,8.84 84.59,8.84
GND on GND: 78.33,9.1 79.55,9.1 79.55,7.88 78.33,7.88
GND on GND: 80.98,13.66 82.2,13.66 82.2,12.44 80.98,12.44
GND on GND: 81.94,13.66 83.16,13.66 83.16,12.44 81.94,12.44
GND on GND: 81.81,27.69 83.03,27.69 83.03,26.47 81.81,26.47
GND on GND: 80.98,5.49 82.2,5.49 82.2,4.27 80.98,4.27
GND on GND: 80.85,20.48 82.07,20.48 82.07,19.26 80.85,19.26
GND on GND: 77.25,25.04 78.47,25.04 78.47,23.82 77.25,23.82
GND on GND: 77.37,9.1 78.59,9.1 78.59,7.88 77.37,7.88
3.3 on 3.3V: 0.26,30.9 89.02,30.9 89.02,0.26 0.26,0.26

Small or netless copper shapes (teardrops, artwork), in the pictures only: 4 on GND

## Text on the board
Top Silkscreen Layer: RX[QN, QP, IN, IP] | TX[QN, QP, IN, IP] | PACHECKO
